# EasyEDA Pro project sle_keyboard.eprj, board PCB1 (continued)
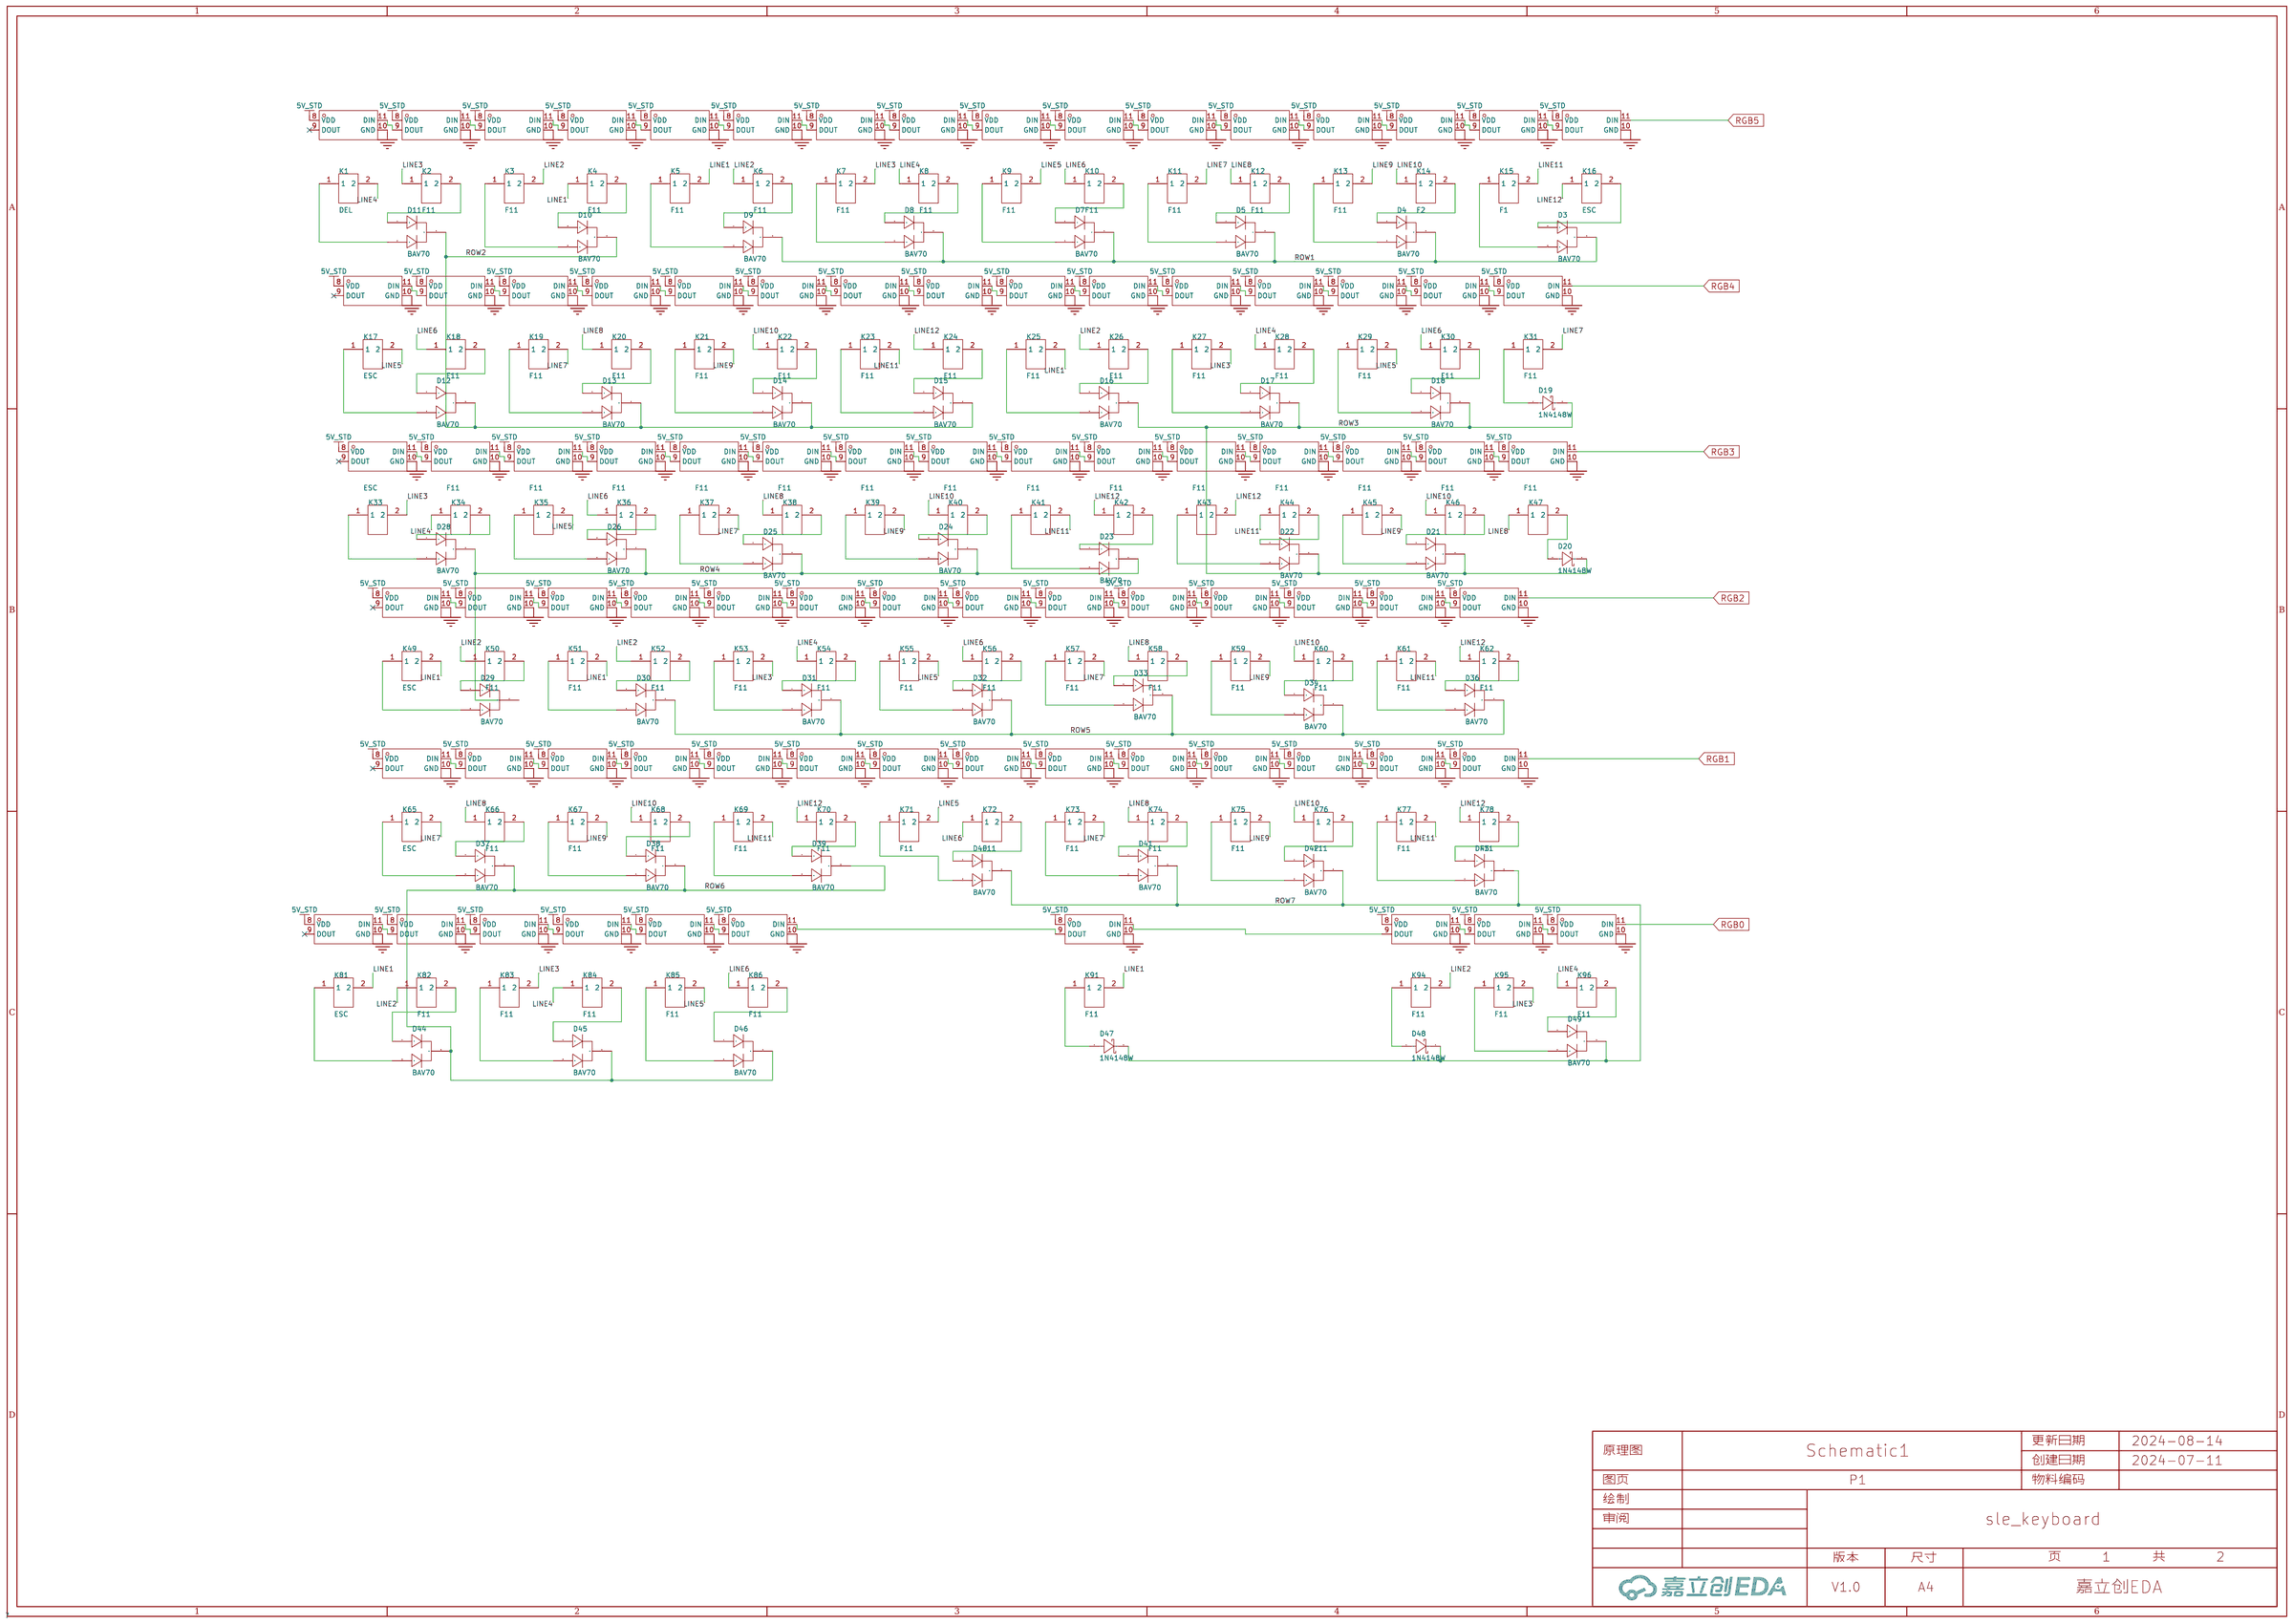
[diagram p0: P1]
## Routing (per net, layer and track width the routed paths; a pad name or vN(x,y) marks a point on that pad's centre or on a via; arc(x,y) is an arc through that point) (continued)
  Bottom Layer w0.508: 109.3,113.32 111.13,113.32 111.79,112.66 111.79,96.09 v1(109.32,93.62) v1(107.85,93.62) ; 4.33,109.15 2.36,107.19 2.36,100.92 3.99,99.3 3.99,90.08 ; 4.33,109.15 v1(4.33,109.15) ; 4.33,109.15 4.24,109.24 4.24,111.86 5.71,113.33 v1(23.76,113.33) 23.76,113.33 ; 4.33,109.15 4.35,109.13 ; v1(137.65,109.86) 137.65,113.4 v1(137.65,113.41) ; 22.9,87.88 22.9,76.52 21.47,75.08 ; 22.9,87.88 25.29,90.26 29.96,90.26 ; 22.9,87.88 22.9,97.65 21.52,99.04 21.52,111.94 22.9,113.33 23.76,113.33 ; 270.72,74.71 269.03,74.71 268.04,75.7 v1(268.04,90.01) 268.04,90.05 v1(267.32,90.78) v1(266.59,91.5) ; v1(61.62,90.02) 61.62,97.75 59.99,99.38 59.99,105.73 60.66,106.4 61.17,106.4 61.64,106.88 61.64,109.67 v1(61.62,109.69) 61.62,113.33 61.64,113.35 ; v1(251.96,113.36) 251.98,113.33 v1(251.98,109.55) ; 19.87,54.28 19.87,54.3 ; 27.59,75.02 27.59,71.65 v1(27.56,71.61) ; 227.03,75.75 232.51,75.75 235.03,73.23 235.03,71.18 ; 227.03,75.75 227.04,75.76 227.04,79.47 229.88,82.31 229.88,85.98 233.22,89.33 233.22,89.69 v1(233.68,90.15) ; 227.03,75.75 v1(227.03,75.75) 227.03,75.74 v1(226.04,74.74) 225.24,74.74 223.17,72.68 v1(223.17,71.88) ; v1(166.82,71.25) 166.82,74.1 167.06,74.35 ; v1(82.69,92.94) 82.69,91.88 81.03,90.22 ; v1(156.59,113.37) 156.59,109.11 v1(156.6,109.1) ; v1(175.64,109.24) 175.64,113.32 v1(175.64,113.32) ; v1(99.59,109.56) 99.59,113.36 v1(99.61,113.37) ; 122.75,52.85 122.76,52.87 122.76,54.17 122.67,54.17 v1(121.23,55.62) 121.23,55.62 v1(119.55,55.62) v1(118.67,55.62) ; v1(232.7,113.39) 232.71,113.38 v1(232.71,109.43) ; v1(42.29,113.39) 42.3,113.38 v1(42.3,109.31) ; 23.76,113.33 26.45,113.33 ; 23.76,113.33 23.91,113.18 v1(23.91,109.13) ; v1(118.88,109.78) 118.88,113.31 118.91,113.34 ; v1(204.24,74.3) 204.1,74.15 v1(204.1,71.57) ; 21.47,75.08 19.36,72.97 19.36,55.31 19.87,54.8 ; 21.47,75.08 25.29,75.08 ; v1(103.99,55.54) 104.05,55.49 v1(104.05,52.1) ; v1(185.24,74.3) 185.25,74.29 v1(185.25,71.21) ; v1(194.5,109.44) 194.5,113.3 v1(194.39,113.41) ; v1(214.09,113.37) 214.12,113.34 v1(214.12,109.26) ; v1(271.27,113.36) 271.27,113.36 v1(271.27,109.19) ; 169.09,13.89 168.43,14.55 168.43,16.4 179.63,27.6 179.63,29.83 181.01,31.21 v1(181.01,36.32) ; 28.31,18.01 28.27,18.05 25.11,18.05 21.16,22 21.16,33.55 23.38,31.33 v1(25.14,31.33) 25.16,31.35 v1(25.95,31.35) 25.96,31.34 v1(26.86,31.34)
  Bottom Layer w1.016: 21.16,33.55 19.66,35.04 v1(19.66,35.43) ; 19.69,39.28 19.65,39.24 19.65,38.62 19.68,38.6 19.68,35.41 ; 21.23,33.48 22.13,33.48 23,34.35 23,42.96 21.73,44.23 19.71,44.23 19.59,44.35 19.59,51.78 19.87,52.06 v1(19.87,52.69) 19.87,53.55 v1(19.87,53.56) 19.87,54.28 v1(19.88,54.3) ; 19.87,54.3 19.87,54.8
  vias: v1(19.7,38.13) v1(19.7,37.17) v1(24.06,75.09) v1(24.53,113.34) v1(25.31,113.34) v1(26.11,113.34) v1(27.58,75.07) v1(27.59,18.02) v1(29.21,90.25) v1(61.64,113.32) v1(108.57,93.61) v1(109.32,113.3) v1(110.14,113.3) v1(110.95,113.3) v1(118.88,113.35) v1(120.45,55.62) v1(122.75,54.16) v1(122.76,53.48) v1(167.07,74.36) v1(226.55,75.27) v1(235.02,71.97) v1(269.33,74.68) v1(270,74.71) v1(270.65,74.73)
+5V: length 272.1
  Top Layer w0.254: 27.07,87.92 27.07,87.32 27.09,87.3 27.09,85.58 ; 27.09,85.58 25.06,85.58 ; 27.09,85.58 27.09,85.57 ; 27.14,85.58 27.19,85.63
  Top Layer w0.508: v1(54.36,88.14) 53.72,87.5 U3.8 ; 244.28,95.11 244.28,94.72 CN2.5 244.8,95.3 244.35,95.76
  Top Layer w0.762: 244.35,95.76 243.59,95.76 ; 47.16,83.69 47.16,82.21 47.33,82.04
  Top Layer w1.016: 26.95,88.39 27.08,88.27 41.27,88.27 41.27,84.46 42.04,83.69 47.16,83.69 ; 26.92,88.42 26.92,92.46 28.89,94.42 76.14,94.42 77.34,95.63 146.94,95.63 150.5,92.08 154.69,92.08 158.37,95.76 243.59,95.76
  Bottom Layer w0.508: v1(54.36,88.14) 54.36,87.12 52.7,85.47 52.7,83 47.16,83
  vias: v1(47.11,82.99) v1(47.9,82.94)
GND: length 575.1
  Top Layer w0.127: U1.31 191.72,11 191.52,10.8 190.82,11.5
  Top Layer w0.178: v1(12.32,50.17) 13.09,49.4 17.46,49.4 ; 23.49,49.25 22.81,49.93 22.11,49.93 ; v1(205.23,33.71) 203.15,33.71 v1(203.13,33.72) ; 21.85,50.02 21.68,49.84 18.1,49.84 17.59,49.34 18.17,48.76 18.17,47.72 ; v2(193.68,3.43) 191.72,1.48 NOREF#12.TP3
  Top Layer w0.203: v1(203.96,5.72) 216.53,5.72 v2(216.53,5.72) v2(216.53,4.95) v2(216.53,4.19) v2(216.53,3.43) v2(216.53,2.67) v2(216.53,1.91) v2(216.53,1.14) ; v2(197.74,5.72) v2(198.5,5.72) v2(199.26,5.72) 197.68,7.29 v1(196.75,7.29) ; v1(199.9,8) 199.9,8.13 v1(199.26,8.76) ; 197.99,12.32 196.67,11 U1.31
  Top Layer w0.254: 200.91,12.61 200.91,12.57 200.18,11.84 199.29,11.84 199.26,11.81 199.26,12.32 ; 200.91,12.61 200.91,13.12 200.06,13.97 C3.2 C4.2 199.51,16.94 X1.4 ; 200.91,12.61 v1(203.06,12.61) v1(204.89,12.61) v1(205.71,12.61) ; C6.2 191.32,19.1 190.92,19.5 185.23,19.5 184.75,19.01 C5.2 C1.1 ; 190.82,11.5 190.52,11.8 U1.45 ; v2(193.68,3.43) R4.2 ; X1.2 197.01,18.83 195.64,18.83 ; 190.72,18.65 190.72,17.19 190.51,16.98 190.51,13.93 ; 195.38,18.97 C8.2 ; v1(203.96,5.72) 204.47,6.23 v1(204.47,6.48) 204.47,6.77 v1(203.96,7.28) 203.96,7.28 v1(203.96,8.26) 203.96,8.51 v1(203.58,8.89) v1(202.95,9.53) v1(202.31,10.16) 201.8,10.67 ; R3.1 v1(195.71,3.43)
  Top Layer w0.28: 207.24,12.81 207.24,9.86
  Top Layer w0.508: 284.55,95.2 284.67,95.07 295.39,95.07 298.03,92.43 298.03,91.77 ; 207.24,9.86 207.19,9.91 205.36,9.91 204.98,10.29 204.72,10.29 ; 246.72,89.19 247.7,88.21 CN2.7 ; CN2.6 247.7,95.18 ; C6.2 191.04,18.7 189.74,18.7 ; 279.31,97.01 279.28,96.98 279.28,91.43 ; K19.10 71.18,91.59 CN1.3 ; v1(241.94,94.36) 241.94,93.85 ; 241.94,93.85 241.94,92.5 K28.10 ; 241.94,93.85 v1(242.19,93.6) 242.84,93.6 v1(242.94,93.5) ; 49.91,85.34 49.53,84.96 U3.3 45.41,84.96 45.21,85.17 ; 49.91,85.34 v1(50.16,85.6) ; 49.91,85.34 50.16,85.09 v1(50.16,84.33) 50.16,82.09 50.21,82.04 ; v1(204.72,10.03) 204.47,10.29 v1(204.03,10.29) 203.91,10.16 v1(202.31,10.16) ; 222.35,91.58 224.15,91.58 v1(225.55,90.17) ; C4.2 200.41,16.39 200.41,19.18 199.9,19.69 195.96,19.69 195.51,19.24 C8.2 ; 206.18,90.16 204.74,91.6 203.18,91.6 ; v1(185.17,4.95) 185.35,4.95 C2.2 ; v1(50.16,86.87) 50.16,85.85 50.29,85.73
  Top Layer w0.762: 48.42,82.04 C14.2 ; v1(225.55,90.17) 227.05,90.17 L2.2 ; L3.1 v1(231.75,90.15) 231.78,90.17 ; R22.1 153.38,15.42 R23.1 150.67,16.51 148.59,16.51 147.32,15.24 147.32,12.7 148.21,11.81 U5.2 155.07,11.81 156.53,10.35 C22.2 ; 79.25,91.69 78.99,91.44 v1(78.99,91.31) v1(79.76,91.31) 79.79,91.31 79.83,91.35 v1(79.83,92.2) 79.72,92.09 NOREF#4.TP3 76.63,92.09 ; NOREF#14.1 20.71,96.77 v1(49.32,96.77) v1(50.12,96.77) v1(51.07,96.77) v1(78.99,96.77) v1(79.88,96.77) 150.75,96.77 NOREF#2.1 154.27,96.99 v1(231.78,96.99) CN2.6 283.88,96.99 NOREF#5.1 ; C21.1 159.8,11.7 SW2.4 SW2.3
  Top Layer w1.016: SW2.4 159.77,12.8 v1(159.77,14.12) NOREF#11.1 150.37,17.27 149.86,16.76
  Bottom Layer w0.178: v1(195.71,3.43) 197.74,5.46 v2(197.74,5.72)
  Bottom Layer w0.254: 201.58,7.75 203.46,7.75 v1(203.96,8.26) ; 201.68,6.6 203.28,6.6 v1(203.96,7.28) ; v2(193.68,3.43) v1(195.71,3.43) ; 199.17,8.67 v1(199.26,8.76) ; 201.41,6.15 201.62,6.35 v1(203.45,6.35) 204.34,6.35 v1(204.47,6.48)
  Bottom Layer w0.28: v1(198.73,7.94) 198.73,8.23 199.17,8.67 199.17,11.53 199.45,11.81 200.66,11.81 v1(202.31,10.16)
  Bottom Layer w0.508: v1(206.17,90.15) 206.47,90.45 206.47,97.02 ; v1(50.93,86.87) 51.07,87.01 v1(51.07,89.25) v1(51.07,96.77) ; v1(49.32,96.77) v1(49.32,91.12) v1(49.32,88.38) 49.32,86.95 v1(49.4,86.87) ; v1(50.16,86.87) 50.12,86.92 v1(50.12,89.25) v1(50.12,96.77)
  Bottom Layer w0.762: 79.25,91.69 78.99,91.44 v1(78.99,91.31) ; v1(78.99,96.77) v1(78.99,92.2) 78.99,91.69 ; v1(231.75,90.15) 231.78,90.18 v1(231.78,92.36) v1(231.78,93.34) v1(231.78,96.99) ; v1(225.55,97.03) v1(225.55,90.17) ; v1(79.76,91.31) 79.88,91.44 v1(79.88,96.77)
  vias: v1(1.14,93.73) v1(1.52,107.95) v1(1.78,109.98) v1(1.9,51.44) v1(2.16,56.52) v1(2.41,60.45) v1(2.79,112.52) v1(3.81,76.2) v1(3.81,72.64) v1(4.06,39.62) v1(4.06,20.96) v1(4.06,14.86) v1(4.19,37.34) v1(4.19,17.78) v1(4.32,41.4) v1(4.45,3.18) v1(4.7,11.68) v1(5.33,57.15) v1(5.84,95.89) v1(5.84,93.47) v1(5.84,75.06) v1(6.1,38.74) v1(6.23,106.94) v1(6.35,40.26) v1(6.35,37.34) v1(6.6,49.91) v1(7.11,21.97) v1(7.62,17.53) v1(8.26,94.11) v1(8.51,95.76) v1(8.64,62.1) v1(9.02,75.95) v1(9.02,41.99) v1(9.02,38.74) v1(9.53,37.34) v1(9.65,40.26) v1(10.16,56.9) v1(10.29,1.02) v1(10.41,20.57) v1(10.79,40.13) v1(11.3,37.34) v1(11.56,75.31) v1(11.56,38.61) v1(11.68,93.98) v1(11.81,17.53) v1(12.45,64.52) v1(12.7,39.62) v1(12.9,54.62) v1(12.95,57.4) v1(12.95,38.61) v1(12.95,37.34) v1(13.08,95.5) v1(13.59,20.07) v1(14.61,112.14) v1(14.61,110.87) v1(14.73,74.3) v1(14.99,92.84) v1(15.24,34.93) v1(15.24,33.91) v1(15.37,37.59) v1(15.37,32.77) v1(15.37,15.88) v1(15.49,64.01) v1(15.88,54.48) v1(16,112.14) v1(16,110.87) v1(16.29,45.85) v1(16.76,37.59) v1(17.02,35.18) v1(17.14,112.14) v1(17.14,110.87) v1(17.65,37.59) v1(17.78,34.93) v1(17.91,33.4) v1(19.3,79.5) v1(19.56,84.07) v1(19.56,81.03) v1(21.21,73.03) v1(21.97,73.66) v1(22.47,46.3) v1(23.06,45.22) v1(23.88,22.86) v1(24.35,45.9) v1(24.38,73.28) v1(24.51,79.5) v1(24.64,94.87) v1(24.64,81.79) v1(25.15,73.28) v1(25.15,21.08) v1(26.04,37.59) v1(26.54,95.38) v1(28.07,38.35) v1(28.71,81.2) v1(28.7,73.28) v1(28.7,40.13) v1(29.61,86.59) v1(29.76,85.05) v1(29.8,52.91) v1(29.9,51.01) v1(29.97,20.7) v1(30.1,37.34) v1(30.35,39.24) v1(32,52.19) v1(32.64,36.45) v1(33.27,57.4) v1(33.53,111.13) v1(33.53,110.24) v1(33.91,20.32) v1(34.13,51.31) v1(34.16,33.91) v1(34.16,15.49) v1(34.67,111.13) v1(34.67,110.11) v1(34.67,57.4) v1(35.28,50.92) v1(35.94,33.91) v1(36.07,111.13) v1(36.07,110.11) v1(36.83,33.53) v1(36.96,37.85) v1(36.96,15.37) v1(37.08,57.4) v1(37.34,26.54) v1(37.46,39.88) v1(37.59,28.96) v1(37.72,20.57) v1(37.85,22.99) v1(38.1,74.3) v1(38.48,73.15) v1(38.48,15.37) v1(38.61,72.14) v1(39.37,74.17) v1(39.5,57.4) v1(39.88,73.03) v1(39.88,72.14) v1(39.88,14.86) v1(40.26,36.58) v1(40.64,58.67) v1(40.89,73.41) v1(40.89,72.64) v1(41.27,74.3) v1(41.4,93.09) v1(41.53,57.28) v1(42.16,31.75) v1(42.16,26.54) v1(42.29,60.96) v1(42.29,23.37) v1(42.42,92.96) v1(42.42,20.96) v1(42.93,91.31) v1(43.18,72.01) v1(43.18,33.66) v1(43.18,27.56) v1(43.31,39.37) v1(43.69,92.08) v1(44.07,72.9) v1(44.32,92.96) v1(44.32,72.14) v1(44.45,91.06) v1(44.45,58.8) v1(44.7,92.08) v1(44.96,50.29) v1(45.21,54.1) v1(45.47,72.01) v1(45.59,74.17) v1(45.59,49.66) v1(45.72,73.15) v1(45.85,33.91) v1(46.23,61.34) v1(46.23,22.48) v1(46.61,20.57) v1(46.74,93.22) v1(46.74,91.31) v1(46.86,74.3) v1(46.86,73.15) v1(47.5,33.78) v1(47.75,91.19) v1(48.01,93.09) v1(48.13,50.67) v1(48.13,49.02) v1(48.39,47.24) v1(48.51,58.42) v1(48.51,53.47) v1(48.77,60.83) v1(49.02,92.2) v1(49.02,71.5) v1(49.28,46.23) v1(49.4,85.6) v1(49.4,84.33) v1(49.78,72.26) v1(50.04,30.86) v1(50.42,92.71) v1(50.42,88.39) v1(50.55,91.19) v1(50.93,85.6) v1(50.93,84.33) v1(51.18,29.59) v1(51.31,22.23) v1(51.43,88.27) v1(51.69,20.32) v1(51.82,58.55) v1(51.94,53.85) v1(52.07,50.29) v1(52.2,111.25) v1(52.2,89.15) v1(52.7,110.11) v1(52.7,14.86) v1(52.96,111.13) v1(52.96,69.98) v1(53.09,89.15) v1(53.09,47.12) v1(53.09,15.62) v1(53.72,53.98) v1(53.72,15.24) v1(53.85,110.87) v1(54.23,69.98) v1(54.48,50.29) v1(54.48,37.85) v1(54.61,41.53) v1(55.37,20.32) v1(55.88,53.98) v1(56.39,79.25) v1(56.52,46.86) v1(56.52,12.83) v1(56.77,82.3) v1(57.28,80.01) v1(57.28,31.12) v1(57.28,14.48) v1(57.78,50.42) v1(58.42,87.76) v1(58.55,15.62) v1(58.67,53.98) v1(58.8,30.35) v1(58.93,46.74) v1(59.1,85.87) v1(59.31,33.15) v1(59.44,34.8) v1(59.69,42.04) v1(59.69,37.97) v1(60.32,88.27) v1(60.32,78.11) v1(60.32,76.96) v1(60.32,69.98) v1(60.45,46.86) v1(60.45,33.53) v1(60.45,13.46) v1(60.58,50.17) v1(60.58,34.8) v1(60.71,30.61) v1(60.83,53.85) v1(60.96,79.88) v1(61.85,69.98) v1(62.1,77.09) v1(62.61,73.41) v1(62.87,88.52) v1(62.87,79.88) v1(63.12,69.98) v1(63.12,34.67) v1(63.25,54.1) v1(63.25,33.27) v1(63.37,87.63) v1(63.37,86.36) v1(63.5,58.29) v1(63.63,73.28) v1(63.75,72.39) v1(64.01,41.53) v1(64.14,34.54) v1(64.39,77.34) v1(64.52,37.85) v1(64.64,33.27) v1(64.9,88.39) v1(65.02,79.63) v1(65.15,73.41) v1(65.28,72.39) v1(65.41,34.67) v1(66.17,77.09) v1(66.29,73.41) v1(66.55,70.36) v1(66.55,33.27) v1(66.68,61.98) v1(66.8,78.23) v1(67.06,59.18) v1(67.06,34.93) v1(67.18,88.39) v1(67.56,71.5) v1(67.95,49.66) v1(68.2,34.8) v1(68.33,72.39) v1(68.45,70.23) v1(68.45,37.97) v1(68.58,77.22) v1(68.58,71.37) v1(68.96,88.27) v1(69.09,23.75) v1(69.09,20.57) v1(69.22,41.78) v1(69.47,33.27) v1(69.6,112.27) v1(70.1,34.8) v1(70.48,88.27) v1(70.61,78.11) v1(70.74,112.27) v1(70.74,29.97) v1(71.12,77.34) v1(71.12,33.27) v1(71.37,57.79) v1(71.5,59.18) v1(71.5,15.62) v1(71.88,111) v1(72.01,60.71) v1(72.14,22.86) v1(72.26,34.67) v1(72.52,14.86) v1(72.9,112.27) v1(72.9,78.11) v1(72.9,77.09) v1(73.03,33.4) v1(73.13,28.72) v1(73.28,59.82) v1(73.28,37.72) v1(73.41,109.35) v1(74.04,77.98) v1(74.04,57.66) v1(74.17,108.59) v1(74.17,46.23) v1(74.3,61.47) v1(74.3,58.67) v1(74.3,14.86) v1(74.55,15.62) v1(74.8,110.62) v1(74.93,20.07) v1(75.06,105.54) v1(75.18,50.29) v1(75.44,109.6) v1(75.57,104.01) v1(75.69,60.21) v1(75.95,105.54) v1(76.07,108.59) v1(76.07,58.55) v1(76.2,110.49) v1(76.2,54.36) v1(76.2,22.48) v1(77.09,78.61) v1(77.09,53.21) v1(77.34,80.01) v1(77.6,110.74) v1(77.6,105.66) v1(77.72,108.59) v1(77.98,57.53) v1(78.11,109.73) v1(78.23,13.46) v1(78.36,21.08) v1(78.61,54.23) v1(78.74,77.85) v1(78.74,38.23) v1(78.87,110.36) v1(79.5,108.59) v1(79.63,58.67) v1(79.63,53.85) v1(79.76,57.66) v1(80.14,77.85) v1(80.14,52.96) v1(80.46,23.9) v1(80.77,72.52) v1(80.77,70.23) v1(81.03,71.76) v1(81.03,41.91) v1(81.41,80.01) v1(81.53,20.57) v1(81.66,77.72) v1(82.04,72.52) v1(82.17,71.76) v1(82.55,99.06) v1(83.57,112.4) v1(83.57,77.72) v1(83.69,72.77) v1(83.69,57.66) v1(83.95,71.88) v1(84.33,58.8) v1(84.33,26.54) v1(84.46,70.23) v1(84.71,99.95) v1(84.84,72.77) v1(84.96,79.5) v1(85.09,30.86) v1(85.22,112.27) v1(85.22,100.92) v1(85.34,77.6) v1(85.47,78.49) v1(85.47,59.69) v1(85.47,58.04) v1(85.47,34.8) v1(85.6,70.23) v1(85.73,61.47) v1(85.98,33.78) v1(86.11,72.77) v1(86.11,72.01) v1(86.36,37.72) v1(86.61,20.57) v1(86.87,33.78) v1(87,58.93) v1(87.25,60.2) v1(87.38,72.52) v1(87.38,61.6) v1(87.5,77.72) v1(88.01,35.31) v1(88.27,112.14) v1(88.52,77.6) v1(89.15,34.29) v1(89.15,20.83) v1(89.54,35.31) v1(89.79,31.12) v1(89.92,77.47) v1(89.92,57.02) v1(90.17,34.16) v1(90.3,112.14) v1(90.3,25.27) v1(90.55,92.46) v1(90.55,15.88) v1(90.93,110.62) v1(90.93,35.18) v1(91.06,91.57) v1(91.69,34.04) v1(91.95,12.83) v1(92.08,92.46) v1(92.08,35.31) v1(92.08,14.86) v1(92.2,57.02) v1(92.33,23.37) v1(92.46,37.59) v1(92.58,110.87) v1(92.71,83.82) v1(93.09,15.49) v1(93.34,91.31) v1(93.6,110.49) v1(93.73,92.46) v1(93.85,77.22) v1(93.98,30.99) v1(93.98,21.21) v1(94.23,87.38) v1(94.23,12.83) v1(94.36,78.49) v1(94.36,16) v1(94.49,85.34) v1(94.87,82.8) v1(95,112.14) v1(95,91.44) v1(95,80.39) v1(95.12,57.02) v1(95.12,54.48) v1(95.12,53.09) v1(95.12,15.11) v1(95.38,77.22) v1(95.63,92.46) v1(95.89,78.61) v1(95.89,22.61) v1(96.14,85.98) v1(96.27,15.75) v1(96.39,12.95) v1(96.77,89.79) v1(96.77,87.38) v1(96.77,3.43) v1(97.03,0.76) v1(97.28,52.96) v1(97.28,30.1) v1(97.66,53.98) v1(97.92,12.83) v1(98.43,90.42) v1(98.43,53.21) v1(98.68,91.31) v1(98.81,57.02) v1(98.93,53.98) v1(99.06,45.85) v1(99.19,78.61) v1(99.19,13.46) v1(99.31,20.96) v1(99.57,89.66) v1(99.57,39.37) v1(99.7,48.77) v1(99.7,3.56) v1(99.82,54.1) v1(99.82,42.29) v1(100.08,73.28) v1(100.08,72.14) v1(100.08,37.85) v1(100.2,77.85) v1(100.46,57.02) v1(100.71,70.36) v1(100.97,12.7) v1(101.22,73.15) v1(101.47,79.76) v1(101.47,72.14) v1(101.98,30.99) v1(102.11,77.85) v1(102.74,17.27) v1(103,73.28) v1(103.12,3.43) v1(103.38,72.14) v1(103.51,79.25) v1(103.81,57.02) v1(104.27,81.54) v1(104.27,79.62) v1(104.27,20.32) v1(104.27,5.69) v1(104.39,73.15) v1(104.39,17.02) v1(104.65,78.11) v1(104.78,70.23) v1(104.9,35.05) v1(105.03,54.23) v1(105.03,39.5) v1(105.03,31.75) v1(105.16,34.04) v1(105.28,0.76) v1(105.54,57.02) v1(105.66,37.97) v1(105.79,35.18) v1(105.92,77.6) v1(106.05,71.88) v1(106.3,33.91) v1(106.43,20.83) v1(107.01,35) v1(107.01,28.81) v1(107.19,57.02) v1(108.08,7.62) v1(108.33,37.59) v1(108.46,77.85) v1(108.59,33.91) v1(108.71,35.18) v1(108.97,56.9) v1(109.12,111.77) v1(109.09,16.64) v1(109.35,110.49) v1(109.35,12.7) v1(109.47,89.54) v1(109.73,111.13) v1(109.86,92.2) v1(109.86,15.49) v1(109.98,91.06) v1(109.98,34.04) v1(110.11,35.05) v1(110.36,111.63) v1(110.49,110.36) v1(110.49,57.02) v1(110.49,12.83) v1(111.25,92.46) v1(111.25,91.19) v1(111.63,89.54) v1(112.14,57.15) v1(112.65,16.51) v1(112.78,111.51) v1(112.78,110.36) v1(112.9,92.33) v1(112.9,15.24) v1(113.03,91.19) v1(113.16,1.02) v1(113.28,39.37) v1(113.41,30.61) v1(113.54,111) v1(113.79,111.63) v1(113.79,77.6) v1(113.79,57.15) v1(114.3,54.1) v1(115.06,79.25) v1(115.06,4.45) v1(115.32,89.54) v1(115.32,57.15) v1(115.57,16.76) v1(115.7,38.1) v1(115.7,20.7) v1(115.95,53.98) v1(116.46,30.73) v1(116.59,77.72) v1(116.71,90.81) v1(116.84,10.67) v1(117.09,15.37) v1(117.09,3.94) v1(117.6,54.1) v1(117.73,57.15) v1(117.86,89.66) v1(118.62,10.92) v1(118.75,9.14) v1(118.87,79.63) v1(118.87,73.15) v1(119.13,72.14) v1(119.25,53.85) v1(119.38,70.23) v1(119.38,57.28) v1(119.38,20.57) v1(119.63,40.64) v1(119.89,72.52) v1(120.02,77.72) v1(120.14,73.28) v1(120.14,58.04) v1(120.14,54.1) v1(120.14,7.11) v1(120.14,0.89) v1(120.52,70.23) v1(120.65,72.14) v1(120.9,57.15) v1(121.03,16.76) v1(121.16,79.63) v1(121.16,58.42) v1(121.3,73.24) v1(121.67,72.14) v1(121.67,70.23) v1(121.92,10.54) v1(121.92,3.56) v1(122.05,30.99) v1(122.05,8.51) v1(122.17,57.79) v1(122.94,79.5) v1(123.06,81.41) v1(123.95,33.91) v1(123.95,16.76) v1(124.08,73.28) v1(124.08,37.59) v1(124.08,34.8) v1(124.21,72.26) v1(124.21,70.23) v1(124.21,32.89) v1(124.21,20.57) v1(124.46,77.72) v1(124.59,72.9) v1(124.97,75.82) v1(124.97,72.01) v1(124.97,70.23) v1(125.09,41.53) v1(125.09,10.03) v1(125.22,32.77) v1(125.35,73.28) v1(125.35,34.8) v1(125.35,3.56) v1(125.48,33.66) v1(125.6,15.49) v1(126.75,76.45) v1(127.13,83.82) v1(127.13,56.01) v1(127.25,34.67) v1(127.38,87.76) v1(127.64,70.23) v1(127.64,33.53) v1(127.64,32.89) v1(127.89,29.72) v1(128.02,7.11) v1(128.14,26.04) v1(128.27,20.57) v1(128.4,56.01) v1(128.4,39.5) v1(128.65,37.85) v1(128.78,92.58) v1(128.78,70.23) v1(128.91,111.63) v1(129.03,110.36) v1(129.03,22.35) v1(129.16,91.19) v1(129.29,89.41) v1(129.29,34.54) v1(129.41,83.44) v1(129.41,32.77) v1(129.41,28.45) v1(129.54,56.01) v1(129.67,91.82) v1(129.67,10.29) v1(129.92,33.53) v1(129.92,7.87) v1(130.05,92.58) v1(130.05,29.85) v1(130.18,111.38) v1(130.18,34.93) v1(130.3,32.77) v1(130.3,1.52) v1(130.43,91.19) v1(130.56,110.36) v1(130.56,89.41) v1(130.81,56.01) v1(131.54,51.05) v1(131.7,92.58) v1(131.7,83.69) v1(131.83,75.95) v1(131.95,87.63) v1(131.95,77.85) v1(132.08,39.62) v1(132.21,85.34) v1(132.21,56.13) v1(132.33,111.63) v1(132.72,30.73) v1(132.84,89.41) v1(133.1,79.5) v1(133.1,55.37) v1(133.22,92.58) v1(133.22,56.13) v1(133.35,76.58) v1(133.35,10.8) v1(133.48,91.19) v1(133.48,53.21) v1(133.6,6.35) v1(133.73,81.03) v1(133.86,7.87) v1(134.11,52.58) v1(134.37,92.58) v1(134.37,30.35) v1(134.49,77.85) v1(134.49,56.01) v1(134.75,53.34) v1(134.75,9.65) v1(134.75,1.02) v1(135.13,89.41) v1(135.13,85.6) v1(135.25,107.7) v1(135.25,91.31) v1(135.25,87.63) v1(135.38,92.46) v1(135.38,76.2) v1(135.38,17.53) v1(135.51,55.37) v1(135.76,51.05) v1(135.76,8.51) v1(135.76,6.35) v1(136.14,45.09) v1(136.27,109.35) v1(136.4,39.62) v1(136.78,108.2) v1(137.03,22.1) v1(137.08,51.05) v1(137.16,89.79) v1(137.29,52.71) v1(137.54,53.34) v1(137.54,40.77) v1(137.61,23.88) v1(137.67,46.23) v1(137.67,42.37) v1(137.67,39) v1(137.8,90.17) v1(137.8,70.23) v1(137.92,89.41) v1(138.18,72.01) v1(138.21,53.34) v1(138.3,73.41) v1(138.3,52.71) v1(138.3,6.35) v1(138.43,4.06) v1(138.68,72.64) v1(138.68,70.23) v1(138.68,49.15) v1(138.94,14.48) v1(139.06,53.34) v1(139.19,42.16) v1(139.19,39.81) v1(139.19,17.15) v1(139.32,72.01) v1(139.45,73.28) v1(139.45,52.83) v1(139.73,92.72) v1(139.7,77.09) v1(139.7,70.23) v1(139.7,1.4) v1(140.08,72.64) v1(140.08,53.34) v1(140.08,4.45) v1(140.21,12.83) v1(140.46,79.88) v1(140.59,71.88) v1(140.72,92.84) v1(140.72,73.41) v1(140.84,70.23) v1(141.1,20.57) v1(141.35,8.38) v1(141.48,72.77) v1(141.61,78.11) v1(141.61,30.86) v1(141.99,70.23) v1(142.24,4.32) v1(142.75,33.66) v1(142.94,35.29) v1(142.88,34.42) v1(143.26,70.23) v1(143.38,40.77) v1(143.38,37.72) v1(143.76,60.83) v1(143.89,35.31) v1(143.89,34.54) v1(143.89,33.66) v1(144.02,31.37) v1(144.65,17.78) v1(145.03,4.19) v1(145.25,92.84) v1(145.29,35.31) v1(145.29,12.95) v1(145.41,34.04) v1(145.41,8) v1(145.54,20.7) v1(145.92,34.67) v1(146.05,16.51) v1(146.21,92.72) v1(146.43,87.5) v1(146.42,60.84) v1(146.56,70.23) v1(146.69,68.45) v1(146.81,35.31) v1(146.94,40.01) v1(146.94,34.04) v1(146.94,4.45) v1(147.32,60.96) v1(147.45,91.69) v1(147.57,70.23) v1(147.7,90.93) v1(147.83,34.93) v1(147.96,110.11) v1(148.08,111.51) v1(148.34,90.81) v1(148.34,87.88) v1(148.34,68.45) v1(148.46,60.83) v1(148.72,38.1) v1(148.84,108.08) v1(148.84,9.14) v1(149.1,20.96) v1(149.22,8) v1(149.61,111.38) v1(149.61,110.11) v1(149.61,32.39) v1(149.86,60.83) v1(149.99,61.6) v1(149.99,4.45) v1(150.37,1.65) v1(150.62,77.47) v1(150.62,23.11) v1(151,110.11) v1(151,60.96) v1(151.13,62.1) v1(151.26,62.99) v1(151.26,21.84) v1(151.64,76.07) v1(152.15,111.51) v1(152.15,31.37) v1(152.4,52.96) v1(152.4,38.1) v1(152.53,77.98) v1(152.53,54.1) v1(152.53,4.45) v1(152.65,108.08) v1(152.78,111.51) v1(153.29,54.1) v1(153.29,52.96) v1(153.92,80.39) v1(153.92,75.95) v1(154.18,4.32) v1(154.93,109.19) v1(155.07,111.63) v1(155.19,54.1) v1(155.19,53.09) v1(155.83,24.51) v1(155.83,22.73) v1(155.83,4.57) v1(155.96,54.1) v1(156.21,77.85) v1(156.59,68.45) v1(156.59,53.21) v1(156.59,37.97) v1(156.84,54.1) v1(156.97,76.2) v1(157.61,70.36) v1(157.88,54.1) v1(158.12,4.45) v1(158.24,72.52) v1(158.5,1.91) v1(159,68.45) v1(159.77,94.11) v1(159.77,26.42) v1(159.89,70.36) v1(159.89,65.02) v1(159.89,31.24) v1(160.03,72.52) v1(160.15,79.63) v1(160.15,66.93) v1(160.27,76.45) v1(160.78,68.58) v1(161.04,60.2) v1(161.42,61.47) v1(161.54,62.74) v1(161.54,13.72) v1(161.61,72.52) v1(161.93,34.93) v1(162.05,34.04) v1(162.31,70.36) v1(162.56,60.45) v1(162.69,66.93) v1(162.94,68.45) v1(162.94,34.93) v1(163.07,37.97) v1(163.19,94.11) v1(163.19,76.58) v1(163.32,34.04) v1(163.45,15.88) v1(163.58,31.37) v1(163.7,13.84) v1(163.96,14.86) v1(164.16,35.06) v1(164.34,27.56) v1(164.47,33.78) v1(165.74,88.01) v1(165.97,94.11) v1(165.99,68.63) v1(166.62,111.76) v1(166.62,110.49) v1(167,91.82) v1(167.89,111.76) v1(167.89,110.49) v1(168.28,68.45) v1(168.4,34.29) v1(168.53,91.82) v1(168.53,35.18) v1(168.66,67.44) v1(168.92,111.77) v1(168.92,110.49) v1(168.91,37.97) v1(169.04,90.93) v1(169.04,19.3) v1(169.21,34.81) v1(169.29,93.98) v1(169.29,88.39) v1(169.55,35.43) v1(170.05,110.36) v1(170.18,111.76) v1(170.43,83.95) v1(170.56,76.2) v1(170.56,38.99) v1(170.69,91.95) v1(170.94,80.77) v1(171.07,86.49) v1(171.07,37.85) v1(171.07,17.27) v1(171.32,78.23) v1(171.45,91.95) v1(171.58,91.06) v1(171.58,39.62) v1(172.21,52.96) v1(172.34,75.82) v1(172.47,18.29) v1(172.72,53.98) v1(173.48,68.71) v1(173.61,89.28) v1(173.74,90.42) v1(173.69,54.13) v1(173.74,17.4) v1(173.86,39.24) v1(173.99,52.96) v1(174.62,40.26) v1(174.75,53.85) v1(174.75,46.1) v1(175.01,19.05) v1(175.9,87.5) v1(175.9,80.26) v1(175.9,77.98) v1(176.28,37.72) v1(176.66,78.99) v1(176.66,42.8) v1(176.91,88.65) v1(177.04,76.33) v1(177.04,17.27) v1(177.16,41.91) v1(177.42,47.5) v1(177.67,19.18) v1(177.8,80.52) v1(177.8,42.55) v1(177.93,86.61) v1(178.18,88.39) v1(178.69,73.03) v1(178.69,40.01) v1(178.69,18.16) v1(179.2,77.72) v1(179.2,35.43) v1(179.83,82.8) v1(179.83,37.85) v1(179.96,75.95) v1(180.34,93.73) v1(180.47,88.5) v1(180.47,61.09) v1(180.47,19.18) v1(180.59,62.48) v1(180.72,69.85) v1(180.85,79.38) v1(180.85,60.2) v1(180.85,41.53) v1(180.85,39.24) v1(181.74,73.15) v1(181.86,71.37) v1(181.86,61.85) v1(181.99,93.73) v1(181.99,69.6) v1(181.99,60.45) v1(181.99,35.43) v1(181.99,34.67) v1(181.99,33.78) v1(182.25,30.23) v1(182.37,31.88) v1(182.63,70.74) v1(182.75,73.15) v1(182.75,77.72) v1(182.75,34.54) v1(182.75,33.78) v1(182.75,10.16) v1(182.75,9.27) v1(182.88,35.43) v1(183.13,39.37) v1(183.13,37.72) v1(183.21,31.88) v1(183.26,87.88) v1(183.26,42.16) v1(183.52,88.77) v1(183.64,35.43) v1(183.64,33.78) v1(183.77,34.54) v1(183.77,8) v1(183.9,93.73) v1(183.9,49.66) v1(184.02,73.15) v1(184.53,88.65) v1(184.55,83.57) v1(184.59,15.74) v1(184.78,75.82) v1(184.78,8) v1(184.91,61.09) v1(184.91,60.07) v1(185.42,15.49) v1(185.55,16.38) v1(185.67,91.95) v1(185.67,91.06) v1(185.8,77.22) v1(185.93,56.77) v1(186.06,93.73) v1(186.06,38.23) v1(186.06,34.67) v1(186.17,111.77) v1(186.18,87.5) v1(186.18,73.15) v1(186.31,110.87) v1(186.44,57.28) v1(186.69,61.09) v1(186.82,91.95) v1(186.82,91.06) v1(186.94,88.14) v1(187.07,56.77) v1(187.2,68.71) v1(187.33,83.57) v1(187.58,78.11) v1(187.58,67.31) v1(187.58,6.35) v1(187.71,57.28) v1(187.71,49.53) v1(187.71,39.88) v1(187.83,86.87) v1(187.83,75.69) v1(187.98,111.77) v1(187.98,110.6) v1(188.59,39.12) v1(188.72,89.03) v1(188.85,92.08) v1(188.85,90.93) v1(188.85,77.09) v1(188.98,33.91) v1(188.98,32.89) v1(189.18,30.1) v1(189.36,111.89) v1(189.61,110.49) v1(189.87,32.89) v1(189.99,78.23) v1(190.12,79.76) v1(190.12,77.09) v1(190.25,75.69) v1(190.34,16.23) v1(190.63,54.23) v1(190.63,32.39) v1(190.75,53.47) v1(190.88,98.55) v1(190.88,30.1) v1(191.14,78.87) v1(191.26,52.96) v1(191.39,40.01) v1(191.52,110.62) v1(191.64,98.55) v1(191.77,54.23) v1(191.9,77.85) v1(192.02,29.59) v1(192.15,111.76) v1(192.15,53.59) v1(192.24,28.72) v1(192.41,75.69) v1(192.66,29.97) v1(192.91,54.36) v1(193.68,98.55) v1(193.93,52.96) v1(194.18,80.26) v1(194.44,98.55) v1(194.44,53.34) v1(194.82,52.83) v1(195.2,75.82) v1(195.2,72.9) v1(195.2,72.01) v1(195.2,54.1) v1(195.2,39.75) v1(195.33,68.58) v1(195.45,98.55) v1(195.45,77.98) v1(195.45,53.21) v1(195.45,42.55) v1(195.71,70.23) v1(195.96,79.25) v1(196.09,72.9) v1(196.09,72.01) v1(196.09,54.23) v1(196.6,98.55) v1(197.1,40.64) v1(197.23,75.44) v1(197.23,72.01) v1(197.36,72.9) v1(197.61,76.58) v1(197.61,68.45) v1(197.6,19.51) v1(197.74,98.55) v1(197.74,7.24) v1(197.74,6.48) v1(197.82,66.82) v1(197.99,77.85) v1(198.5,79.38) v1(198.54,7.24) v1(198.51,6.48) v1(198.63,63.37) v1(198.67,12.22) v1(199.19,19.53) v1(199.26,7.24) v1(199.26,6.48) v1(199.39,30.1) v1(199.52,81.78) v1(199.64,76.45) v1(199.64,67.06) v1(199.77,68.45) v1(199.77,35.31) v1(199.77,12.27) v1(200.03,75.44) v1(200.03,39.75) v1(200.03,33.78) v1(200.11,7.24) v1(200.11,6.48) v1(200.15,71.25) v1(200.15,41.91) v1(200.28,34.54) v1(200.66,35.43) v1(200.79,30.1) v1(200.79,18.42) v1(200.91,33.78) v1(201.04,34.42) v1(201.04,7.49) v1(201.17,70.49) v1(201.17,61.6) v1(201.17,60.33) v1(201.17,19.3) v1(201.17,10.03) v1(201.3,77.85) v1(201.42,6.48) v1(201.55,18.29) v1(201.68,9.53) v1(201.81,12.62) v1(202.06,19.18) v1(202.31,60.33) v1(202.31,8.89) v1(202.44,76.58) v1(202.44,61.6) v1(202.56,75.57) v1(202.56,42.42) v1(202.56,39.88) v1(202.69,8.13) v1(202.82,19.05) v1(202.95,18.42) v1(203.07,28.45) v1(203.2,7.37) v1(203.33,10.29) v1(203.45,19.43) v1(204.09,77.6) v1(204.34,68.83) v1(204.34,18.67) v1(204.72,111.51) v1(204.72,110.36) v1(204.72,19.56) v1(205.23,28.19) v1(205.36,9.65) v1(205.49,34.54) v1(205.61,39.62) v1(205.87,111.25) v1(205.87,110.45) v1(205.99,14.61) v1(206.25,68.71) v1(206.47,97.02) v1(206.5,67.18) v1(206.5,35.43) v1(206.5,7.49) v1(206.76,39.37) v1(207.26,111.25) v1(207.26,110.36) v1(207.26,35.94) v1(207.65,75.57) v1(208.15,14.48) v1(208.28,39.37) v1(209.04,17.91) v1(209.04,7.11) v1(209.3,40.01) v1(209.42,8.51) v1(209.55,52.83) v1(209.68,53.59) v1(209.93,30.86) v1(209.93,11.56) v1(210.44,53.59) v1(210.44,52.83) v1(210.7,7.18) v1(210.95,10.03) v1(211.07,29.46) v1(211.33,19.56) v1(211.71,9.27) v1(212.09,18.42) v1(212.22,53.59) v1(212.22,30.99) v1(212.6,52.96) 